# EAGLE board Resistor_Resistor (EAGLE 8.3.0), part 22 of 32
## Placement (x,y rotation side) (continued)
R26721  10K  [0201]  187.5,74.42 0 top
R26722  10K  [0201]  187.5,75.03 0 top
R26723  10K  [0201]  187.5,75.64 0 top
R26724  10K  [0201]  187.5,76.25 0 top
R26725  10K  [0201]  187.5,76.86 0 top
R26726  10K  [0201]  187.5,77.47 0 top
R26727  10K  [0201]  187.5,78.08 0 top
R26728  10K  [0201]  187.5,78.69 0 top
R26729  10K  [0201]  187.5,79.3 0 top
R26730  10K  [0201]  187.5,79.91 0 top
R26731  10K  [0201]  187.5,80.52 0 top
R26732  10K  [0201]  187.5,81.13 0 top
R26733  10K  [0201]  187.5,81.74 0 top
R26734  10K  [0201]  187.5,82.35 0 top
R26735  10K  [0201]  187.5,82.96 0 top
R26736  10K  [0201]  187.5,83.57 0 top
R26737  10K  [0201]  187.5,84.18 0 top
R26738  10K  [0201]  187.5,84.79 0 top
R26739  10K  [0201]  187.5,85.39 0 top
R26740  10K  [0201]  187.5,86 0 top
R26741  10K  [0201]  187.5,86.61 0 top
R26742  10K  [0201]  187.5,87.22 0 top
R26743  10K  [0201]  187.5,87.83 0 top
R26744  10K  [0201]  187.5,88.44 0 top
R26745  10K  [0201]  187.5,89.05 0 top
R26746  10K  [0201]  187.5,89.66 0 top
R26747  10K  [0201]  187.5,90.27 0 top
R26748  10K  [0201]  187.5,90.88 0 top
R26749  10K  [0201]  187.5,91.49 0 top
R26750  10K  [0201]  187.5,92.1 0 top
R26751  10K  [0201]  187.5,92.71 0 top
R26752  10K  [0201]  187.5,93.32 0 top
R26753  10K  [0201]  187.5,93.93 0 top
R26754  10K  [0201]  187.5,94.54 0 top
R26755  10K  [0201]  187.5,95.15 0 top
R26756  10K  [0201]  187.5,95.76 0 top
R26757  10K  [0201]  187.5,96.37 0 top
R26758  10K  [0201]  187.5,96.98 0 top
R26759  10K  [0201]  187.5,97.59 0 top
R26760  10K  [0201]  187.5,98.2 0 top
R26761  10K  [0201]  187.5,98.81 0 top
R26762  10K  [0201]  187.5,99.42 0 top
R26763  10K  [0201]  187.5,100.03 0 top
R26764  10K  [0201]  187.5,100.63 0 top
R26765  10K  [0201]  187.5,101.24 0 top
R26766  10K  [0201]  187.5,101.85 0 top
R26767  10K  [0201]  187.5,102.46 0 top
R26768  10K  [0201]  187.5,103.07 0 top
R26769  10K  [0201]  187.5,103.68 0 top
R26770  10K  [0201]  187.5,104.29 0 top
R26771  10K  [0201]  187.5,104.9 0 top
R26772  10K  [0201]  187.5,105.51 0 top
R26773  10K  [0201]  187.5,106.12 0 top
R26774  10K  [0201]  187.5,106.73 0 top
R26775  10K  [0201]  187.5,107.34 0 top
R26776  10K  [0201]  187.5,107.95 0 top
R26777  10K  [0201]  187.5,108.56 0 top
R26778  10K  [0201]  187.5,109.17 0 top
R26779  10K  [0201]  187.5,109.78 0 top
R26780  10K  [0201]  187.5,110.39 0 top
R26781  10K  [0201]  187.5,111 0 top
R26782  10K  [0201]  187.5,111.61 0 top
R26783  10K  [0201]  187.5,112.22 0 top
R26784  10K  [0201]  187.5,112.83 0 top
R26785  10K  [0201]  187.5,113.44 0 top
R26786  10K  [0201]  187.5,114.05 0 top
R26787  10K  [0201]  187.5,114.66 0 top
R26788  10K  [0201]  187.5,115.27 0 top
R26789  10K  [0201]  187.5,115.87 0 top
R26790  10K  [0201]  187.5,116.48 0 top
R26791  10K  [0201]  187.5,117.09 0 top
R26792  10K  [0201]  187.5,117.7 0 top
R26793  10K  [0201]  187.5,118.31 0 top
R26794  10K  [0201]  187.5,118.92 0 top
R26795  10K  [0201]  187.5,119.53 0 top
R26796  10K  [0201]  187.5,120.14 0 top
R26797  10K  [0201]  187.5,120.75 0 top
R26798  10K  [0201]  187.5,121.36 0 top
R26799  10K  [0201]  187.5,121.97 0 top
R26800  10K  [0201]  187.5,122.58 0 top
R26801  10K  [0201]  188.72,1.27 0 top
R26802  10K  [0201]  188.72,1.88 0 top
R26803  10K  [0201]  188.72,2.49 0 top
R26804  10K  [0201]  188.72,3.1 0 top
R26805  10K  [0201]  188.72,3.71 0 top
R26806  10K  [0201]  188.72,4.32 0 top
R26807  10K  [0201]  188.72,4.93 0 top
R26808  10K  [0201]  188.72,5.54 0 top
R26809  10K  [0201]  188.72,6.15 0 top
R26810  10K  [0201]  188.72,6.76 0 top
R26811  10K  [0201]  188.72,7.37 0 top
R26812  10K  [0201]  188.72,7.98 0 top
R26813  10K  [0201]  188.72,8.59 0 top
R26814  10K  [0201]  188.72,9.19 0 top
R26815  10K  [0201]  188.72,9.8 0 top
R26816  10K  [0201]  188.72,10.41 0 top
R26817  10K  [0201]  188.72,11.02 0 top
R26818  10K  [0201]  188.72,11.63 0 top
R26819  10K  [0201]  188.72,12.24 0 top
R26820  10K  [0201]  188.72,12.85 0 top
R26821  10K  [0201]  188.72,13.46 0 top
R26822  10K  [0201]  188.72,14.07 0 top
R26823  10K  [0201]  188.72,14.68 0 top
R26824  10K  [0201]  188.72,15.29 0 top
R26825  10K  [0201]  188.72,15.9 0 top
R26826  10K  [0201]  188.72,16.51 0 top
R26827  10K  [0201]  188.72,17.12 0 top
R26828  10K  [0201]  188.72,17.73 0 top
R26829  10K  [0201]  188.72,18.34 0 top
R26830  10K  [0201]  188.72,18.95 0 top
R26831  10K  [0201]  188.72,19.56 0 top
R26832  10K  [0201]  188.72,20.17 0 top
R26833  10K  [0201]  188.72,20.78 0 top
R26834  10K  [0201]  188.72,21.39 0 top
R26835  10K  [0201]  188.72,22 0 top
R26836  10K  [0201]  188.72,22.61 0 top
R26837  10K  [0201]  188.72,23.22 0 top
R26838  10K  [0201]  188.72,23.83 0 top
R26839  10K  [0201]  188.72,24.43 0 top
R26840  10K  [0201]  188.72,25.04 0 top
R26841  10K  [0201]  188.72,25.65 0 top
R26842  10K  [0201]  188.72,26.26 0 top
R26843  10K  [0201]  188.72,26.87 0 top
R26844  10K  [0201]  188.72,27.48 0 top
R26845  10K  [0201]  188.72,28.09 0 top
R26846  10K  [0201]  188.72,28.7 0 top
R26847  10K  [0201]  188.72,29.31 0 top
R26848  10K  [0201]  188.72,29.92 0 top
R26849  10K  [0201]  188.72,30.53 0 top
R26850  10K  [0201]  188.72,31.14 0 top
R26851  10K  [0201]  188.72,31.75 0 top
R26852  10K  [0201]  188.72,32.36 0 top
R26853  10K  [0201]  188.72,32.97 0 top
R26854  10K  [0201]  188.72,33.58 0 top
R26855  10K  [0201]  188.72,34.19 0 top
R26856  10K  [0201]  188.72,34.8 0 top
R26857  10K  [0201]  188.72,35.41 0 top
R26858  10K  [0201]  188.72,36.02 0 top
R26859  10K  [0201]  188.72,36.63 0 top
R26860  10K  [0201]  188.72,37.24 0 top
R26861  10K  [0201]  188.72,37.85 0 top
R26862  10K  [0201]  188.72,38.46 0 top
R26863  10K  [0201]  188.72,39.07 0 top
R26864  10K  [0201]  188.72,39.67 0 top
R26865  10K  [0201]  188.72,40.28 0 top
R26866  10K  [0201]  188.72,40.89 0 top
R26867  10K  [0201]  188.72,41.5 0 top
R26868  10K  [0201]  188.72,42.11 0 top
R26869  10K  [0201]  188.72,42.72 0 top
R26870  10K  [0201]  188.72,43.33 0 top
R26871  10K  [0201]  188.72,43.94 0 top
R26872  10K  [0201]  188.72,44.55 0 top
R26873  10K  [0201]  188.72,45.16 0 top
R26874  10K  [0201]  188.72,45.77 0 top
R26875  10K  [0201]  188.72,46.38 0 top
R26876  10K  [0201]  188.72,46.99 0 top
R26877  10K  [0201]  188.72,47.6 0 top
R26878  10K  [0201]  188.72,48.21 0 top
R26879  10K  [0201]  188.72,48.82 0 top
R26880  10K  [0201]  188.72,49.43 0 top
R26881  10K  [0201]  188.72,50.04 0 top
R26882  10K  [0201]  188.72,50.65 0 top
R26883  10K  [0201]  188.72,51.26 0 top
R26884  10K  [0201]  188.72,51.87 0 top
R26885  10K  [0201]  188.72,52.48 0 top
R26886  10K  [0201]  188.72,53.09 0 top
R26887  10K  [0201]  188.72,53.7 0 top
R26888  10K  [0201]  188.72,54.31 0 top
R26889  10K  [0201]  188.72,54.91 0 top
R26890  10K  [0201]  188.72,55.52 0 top
R26891  10K  [0201]  188.72,56.13 0 top
R26892  10K  [0201]  188.72,56.74 0 top
R26893  10K  [0201]  188.72,57.35 0 top
R26894  10K  [0201]  188.72,57.96 0 top
R26895  10K  [0201]  188.72,58.57 0 top
R26896  10K  [0201]  188.72,59.18 0 top
R26897  10K  [0201]  188.72,59.79 0 top
R26898  10K  [0201]  188.72,60.4 0 top
R26899  10K  [0201]  188.72,61.01 0 top
R26900  10K  [0201]  188.72,61.62 0 top
R26901  10K  [0201]  188.72,62.23 0 top
R26902  10K  [0201]  188.72,62.84 0 top
R26903  10K  [0201]  188.72,63.45 0 top
R26904  10K  [0201]  188.72,64.06 0 top
R26905  10K  [0201]  188.72,64.67 0 top
R26906  10K  [0201]  188.72,65.28 0 top
R26907  10K  [0201]  188.72,65.89 0 top
R26908  10K  [0201]  188.72,66.5 0 top
R26909  10K  [0201]  188.72,67.11 0 top
R26910  10K  [0201]  188.72,67.72 0 top
R26911  10K  [0201]  188.72,68.33 0 top
R26912  10K  [0201]  188.72,68.94 0 top
R26913  10K  [0201]  188.72,69.55 0 top
R26914  10K  [0201]  188.72,70.15 0 top
R26915  10K  [0201]  188.72,70.76 0 top
R26916  10K  [0201]  188.72,71.37 0 top
R26917  10K  [0201]  188.72,71.98 0 top
R26918  10K  [0201]  188.72,72.59 0 top
R26919  10K  [0201]  188.72,73.2 0 top
R26920  10K  [0201]  188.72,73.81 0 top
R26921  10K  [0201]  188.72,74.42 0 top
R26922  10K  [0201]  188.72,75.03 0 top
R26923  10K  [0201]  188.72,75.64 0 top
R26924  10K  [0201]  188.72,76.25 0 top
R26925  10K  [0201]  188.72,76.86 0 top
R26926  10K  [0201]  188.72,77.47 0 top
R26927  10K  [0201]  188.72,78.08 0 top
R26928  10K  [0201]  188.72,78.69 0 top
R26929  10K  [0201]  188.72,79.3 0 top
R26930  10K  [0201]  188.72,79.91 0 top
R26931  10K  [0201]  188.72,80.52 0 top
R26932  10K  [0201]  188.72,81.13 0 top
R26933  10K  [0201]  188.72,81.74 0 top
R26934  10K  [0201]  188.72,82.35 0 top
R26935  10K  [0201]  188.72,82.96 0 top
R26936  10K  [0201]  188.72,83.57 0 top
R26937  10K  [0201]  188.72,84.18 0 top
R26938  10K  [0201]  188.72,84.79 0 top
R26939  10K  [0201]  188.72,85.39 0 top
R26940  10K  [0201]  188.72,86 0 top
R26941  10K  [0201]  188.72,86.61 0 top
R26942  10K  [0201]  188.72,87.22 0 top
R26943  10K  [0201]  188.72,87.83 0 top
R26944  10K  [0201]  188.72,88.44 0 top
R26945  10K  [0201]  188.72,89.05 0 top
R26946  10K  [0201]  188.72,89.66 0 top
R26947  10K  [0201]  188.72,90.27 0 top
R26948  10K  [0201]  188.72,90.88 0 top
R26949  10K  [0201]  188.72,91.49 0 top
R26950  10K  [0201]  188.72,92.1 0 top
R26951  10K  [0201]  188.72,92.71 0 top
R26952  10K  [0201]  188.72,93.32 0 top
R26953  10K  [0201]  188.72,93.93 0 top
R26954  10K  [0201]  188.72,94.54 0 top
R26955  10K  [0201]  188.72,95.15 0 top
R26956  10K  [0201]  188.72,95.76 0 top
R26957  10K  [0201]  188.72,96.37 0 top
R26958  10K  [0201]  188.72,96.98 0 top
R26959  10K  [0201]  188.72,97.59 0 top
R26960  10K  [0201]  188.72,98.2 0 top
R26961  10K  [0201]  188.72,98.81 0 top
R26962  10K  [0201]  188.72,99.42 0 top
R26963  10K  [0201]  188.72,100.03 0 top
R26964  10K  [0201]  188.72,100.63 0 top
R26965  10K  [0201]  188.72,101.24 0 top
R26966  10K  [0201]  188.72,101.85 0 top
R26967  10K  [0201]  188.72,102.46 0 top
R26968  10K  [0201]  188.72,103.07 0 top
R26969  10K  [0201]  188.72,103.68 0 top
R26970  10K  [0201]  188.72,104.29 0 top
R26971  10K  [0201]  188.72,104.9 0 top
R26972  10K  [0201]  188.72,105.51 0 top
R26973  10K  [0201]  188.72,106.12 0 top
R26974  10K  [0201]  188.72,106.73 0 top
R26975  10K  [0201]  188.72,107.34 0 top
R26976  10K  [0201]  188.72,107.95 0 top
R26977  10K  [0201]  188.72,108.56 0 top
R26978  10K  [0201]  188.72,109.17 0 top
R26979  10K  [0201]  188.72,109.78 0 top
R26980  10K  [0201]  188.72,110.39 0 top
R26981  10K  [0201]  188.72,111 0 top
R26982  10K  [0201]  188.72,111.61 0 top
R26983  10K  [0201]  188.72,112.22 0 top
R26984  10K  [0201]  188.72,112.83 0 top
R26985  10K  [0201]  188.72,113.44 0 top
R26986  10K  [0201]  188.72,114.05 0 top
R26987  10K  [0201]  188.72,114.66 0 top
R26988  10K  [0201]  188.72,115.27 0 top
R26989  10K  [0201]  188.72,115.87 0 top
R26990  10K  [0201]  188.72,116.48 0 top
R26991  10K  [0201]  188.72,117.09 0 top
R26992  10K  [0201]  188.72,117.7 0 top
R26993  10K  [0201]  188.72,118.31 0 top
R26994  10K  [0201]  188.72,118.92 0 top
R26995  10K  [0201]  188.72,119.53 0 top
R26996  10K  [0201]  188.72,120.14 0 top
R26997  10K  [0201]  188.72,120.75 0 top
R26998  10K  [0201]  188.72,121.36 0 top
R26999  10K  [0201]  188.72,121.97 0 top
R27000  10K  [0201]  188.72,122.58 0 top
R27001  10K  [0201]  189.94,1.27 0 top
R27002  10K  [0201]  189.94,1.88 0 top
R27003  10K  [0201]  189.94,2.49 0 top
R27004  10K  [0201]  189.94,3.1 0 top
R27005  10K  [0201]  189.94,3.71 0 top
R27006  10K  [0201]  189.94,4.32 0 top
R27007  10K  [0201]  189.94,4.93 0 top
R27008  10K  [0201]  189.94,5.54 0 top
R27009  10K  [0201]  189.94,6.15 0 top
R27010  10K  [0201]  189.94,6.76 0 top
R27011  10K  [0201]  189.94,7.37 0 top
R27012  10K  [0201]  189.94,7.98 0 top
R27013  10K  [0201]  189.94,8.59 0 top
R27014  10K  [0201]  189.94,9.19 0 top
R27015  10K  [0201]  189.94,9.8 0 top
R27016  10K  [0201]  189.94,10.41 0 top
R27017  10K  [0201]  189.94,11.02 0 top
R27018  10K  [0201]  189.94,11.63 0 top
R27019  10K  [0201]  189.94,12.24 0 top
R27020  10K  [0201]  189.94,12.85 0 top
R27021  10K  [0201]  189.94,13.46 0 top
R27022  10K  [0201]  189.94,14.07 0 top
R27023  10K  [0201]  189.94,14.68 0 top
R27024  10K  [0201]  189.94,15.29 0 top
R27025  10K  [0201]  189.94,15.9 0 top
R27026  10K  [0201]  189.94,16.51 0 top
R27027  10K  [0201]  189.94,17.12 0 top
R27028  10K  [0201]  189.94,17.73 0 top
R27029  10K  [0201]  189.94,18.34 0 top
R27030  10K  [0201]  189.94,18.95 0 top
R27031  10K  [0201]  189.94,19.56 0 top
R27032  10K  [0201]  189.94,20.17 0 top
R27033  10K  [0201]  189.94,20.78 0 top
R27034  10K  [0201]  189.94,21.39 0 top
R27035  10K  [0201]  189.94,22 0 top
R27036  10K  [0201]  189.94,22.61 0 top
R27037  10K  [0201]  189.94,23.22 0 top
R27038  10K  [0201]  189.94,23.83 0 top
R27039  10K  [0201]  189.94,24.43 0 top
R27040  10K  [0201]  189.94,25.04 0 top
R27041  10K  [0201]  189.94,25.65 0 top
R27042  10K  [0201]  189.94,26.26 0 top
R27043  10K  [0201]  189.94,26.87 0 top
R27044  10K  [0201]  189.94,27.48 0 top
R27045  10K  [0201]  189.94,28.09 0 top
R27046  10K  [0201]  189.94,28.7 0 top
R27047  10K  [0201]  189.94,29.31 0 top
R27048  10K  [0201]  189.94,29.92 0 top
R27049  10K  [0201]  189.94,30.53 0 top
R27050  10K  [0201]  189.94,31.14 0 top
R27051  10K  [0201]  189.94,31.75 0 top
R27052  10K  [0201]  189.94,32.36 0 top
R27053  10K  [0201]  189.94,32.97 0 top
R27054  10K  [0201]  189.94,33.58 0 top
R27055  10K  [0201]  189.94,34.19 0 top
R27056  10K  [0201]  189.94,34.8 0 top
R27057  10K  [0201]  189.94,35.41 0 top
R27058  10K  [0201]  189.94,36.02 0 top
R27059  10K  [0201]  189.94,36.63 0 top
R27060  10K  [0201]  189.94,37.24 0 top
R27061  10K  [0201]  189.94,37.85 0 top
R27062  10K  [0201]  189.94,38.46 0 top
R27063  10K  [0201]  189.94,39.07 0 top
R27064  10K  [0201]  189.94,39.67 0 top
R27065  10K  [0201]  189.94,40.28 0 top
R27066  10K  [0201]  189.94,40.89 0 top
R27067  10K  [0201]  189.94,41.5 0 top
R27068  10K  [0201]  189.94,42.11 0 top
R27069  10K  [0201]  189.94,42.72 0 top
R27070  10K  [0201]  189.94,43.33 0 top
R27071  10K  [0201]  189.94,43.94 0 top
R27072  10K  [0201]  189.94,44.55 0 top
R27073  10K  [0201]  189.94,45.16 0 top
R27074  10K  [0201]  189.94,45.77 0 top
R27075  10K  [0201]  189.94,46.38 0 top
R27076  10K  [0201]  189.94,46.99 0 top
R27077  10K  [0201]  189.94,47.6 0 top
R27078  10K  [0201]  189.94,48.21 0 top
R27079  10K  [0201]  189.94,48.82 0 top
R27080  10K  [0201]  189.94,49.43 0 top
R27081  10K  [0201]  189.94,50.04 0 top
R27082  10K  [0201]  189.94,50.65 0 top
R27083  10K  [0201]  189.94,51.26 0 top
R27084  10K  [0201]  189.94,51.87 0 top
R27085  10K  [0201]  189.94,52.48 0 top
R27086  10K  [0201]  189.94,53.09 0 top
R27087  10K  [0201]  189.94,53.7 0 top
R27088  10K  [0201]  189.94,54.31 0 top
R27089  10K  [0201]  189.94,54.91 0 top
R27090  10K  [0201]  189.94,55.52 0 top
R27091  10K  [0201]  189.94,56.13 0 top
R27092  10K  [0201]  189.94,56.74 0 top
R27093  10K  [0201]  189.94,57.35 0 top
R27094  10K  [0201]  189.94,57.96 0 top
R27095  10K  [0201]  189.94,58.57 0 top
R27096  10K  [0201]  189.94,59.18 0 top
R27097  10K  [0201]  189.94,59.79 0 top
R27098  10K  [0201]  189.94,60.4 0 top
R27099  10K  [0201]  189.94,61.01 0 top
R27100  10K  [0201]  189.94,61.62 0 top
R27101  10K  [0201]  189.94,62.23 0 top
R27102  10K  [0201]  189.94,62.84 0 top
R27103  10K  [0201]  189.94,63.45 0 top
R27104  10K  [0201]  189.94,64.06 0 top
R27105  10K  [0201]  189.94,64.67 0 top
R27106  10K  [0201]  189.94,65.28 0 top
R27107  10K  [0201]  189.94,65.89 0 top
R27108  10K  [0201]  189.94,66.5 0 top
R27109  10K  [0201]  189.94,67.11 0 top
R27110  10K  [0201]  189.94,67.72 0 top
R27111  10K  [0201]  189.94,68.33 0 top
R27112  10K  [0201]  189.94,68.94 0 top
R27113  10K  [0201]  189.94,69.55 0 top
R27114  10K  [0201]  189.94,70.15 0 top
R27115  10K  [0201]  189.94,70.76 0 top
R27116  10K  [0201]  189.94,71.37 0 top
R27117  10K  [0201]  189.94,71.98 0 top
R27118  10K  [0201]  189.94,72.59 0 top
R27119  10K  [0201]  189.94,73.2 0 top
R27120  10K  [0201]  189.94,73.81 0 top
R27121  10K  [0201]  189.94,74.42 0 top
R27122  10K  [0201]  189.94,75.03 0 top
R27123  10K  [0201]  189.94,75.64 0 top
R27124  10K  [0201]  189.94,76.25 0 top
R27125  10K  [0201]  189.94,76.86 0 top
R27126  10K  [0201]  189.94,77.47 0 top
R27127  10K  [0201]  189.94,78.08 0 top
R27128  10K  [0201]  189.94,78.69 0 top
R27129  10K  [0201]  189.94,79.3 0 top
R27130  10K  [0201]  189.94,79.91 0 top
R27131  10K  [0201]  189.94,80.52 0 top
R27132  10K  [0201]  189.94,81.13 0 top
R27133  10K  [0201]  189.94,81.74 0 top
R27134  10K  [0201]  189.94,82.35 0 top
R27135  10K  [0201]  189.94,82.96 0 top
R27136  10K  [0201]  189.94,83.57 0 top
R27137  10K  [0201]  189.94,84.18 0 top
R27138  10K  [0201]  189.94,84.79 0 top
R27139  10K  [0201]  189.94,85.39 0 top
R27140  10K  [0201]  189.94,86 0 top
R27141  10K  [0201]  189.94,86.61 0 top
R27142  10K  [0201]  189.94,87.22 0 top
R27143  10K  [0201]  189.94,87.83 0 top
R27144  10K  [0201]  189.94,88.44 0 top
R27145  10K  [0201]  189.94,89.05 0 top
R27146  10K  [0201]  189.94,89.66 0 top
R27147  10K  [0201]  189.94,90.27 0 top
R27148  10K  [0201]  189.94,90.88 0 top
R27149  10K  [0201]  189.94,91.49 0 top
R27150  10K  [0201]  189.94,92.1 0 top
R27151  10K  [0201]  189.94,92.71 0 top
R27152  10K  [0201]  189.94,93.32 0 top
R27153  10K  [0201]  189.94,93.93 0 top
R27154  10K  [0201]  189.94,94.54 0 top
R27155  10K  [0201]  189.94,95.15 0 top
R27156  10K  [0201]  189.94,95.76 0 top
R27157  10K  [0201]  189.94,96.37 0 top
R27158  10K  [0201]  189.94,96.98 0 top
R27159  10K  [0201]  189.94,97.59 0 top
R27160  10K  [0201]  189.94,98.2 0 top
R27161  10K  [0201]  189.94,98.81 0 top
R27162  10K  [0201]  189.94,99.42 0 top
R27163  10K  [0201]  189.94,100.03 0 top
R27164  10K  [0201]  189.94,100.63 0 top
R27165  10K  [0201]  189.94,101.24 0 top
R27166  10K  [0201]  189.94,101.85 0 top
R27167  10K  [0201]  189.94,102.46 0 top
R27168  10K  [0201]  189.94,103.07 0 top
R27169  10K  [0201]  189.94,103.68 0 top
R27170  10K  [0201]  189.94,104.29 0 top
R27171  10K  [0201]  189.94,104.9 0 top
R27172  10K  [0201]  189.94,105.51 0 top
R27173  10K  [0201]  189.94,106.12 0 top
R27174  10K  [0201]  189.94,106.73 0 top
R27175  10K  [0201]  189.94,107.34 0 top
R27176  10K  [0201]  189.94,107.95 0 top
R27177  10K  [0201]  189.94,108.56 0 top
R27178  10K  [0201]  189.94,109.17 0 top
R27179  10K  [0201]  189.94,109.78 0 top
R27180  10K  [0201]  189.94,110.39 0 top
R27181  10K  [0201]  189.94,111 0 top
R27182  10K  [0201]  189.94,111.61 0 top
R27183  10K  [0201]  189.94,112.22 0 top
R27184  10K  [0201]  189.94,112.83 0 top
R27185  10K  [0201]  189.94,113.44 0 top
R27186  10K  [0201]  189.94,114.05 0 top
R27187  10K  [0201]  189.94,114.66 0 top
R27188  10K  [0201]  189.94,115.27 0 top
R27189  10K  [0201]  189.94,115.87 0 top
R27190  10K  [0201]  189.94,116.48 0 top
R27191  10K  [0201]  189.94,117.09 0 top
R27192  10K  [0201]  189.94,117.7 0 top
R27193  10K  [0201]  189.94,118.31 0 top
R27194  10K  [0201]  189.94,118.92 0 top
R27195  10K  [0201]  189.94,119.53 0 top
R27196  10K  [0201]  189.94,120.14 0 top
R27197  10K  [0201]  189.94,120.75 0 top
R27198  10K  [0201]  189.94,121.36 0 top
R27199  10K  [0201]  189.94,121.97 0 top
R27200  10K  [0201]  189.94,122.58 0 top
R27201  10K  [0201]  191.16,1.27 0 top
R27202  10K  [0201]  191.16,1.88 0 top
R27203  10K  [0201]  191.16,2.49 0 top
R27204  10K  [0201]  191.16,3.1 0 top
R27205  10K  [0201]  191.16,3.71 0 top
R27206  10K  [0201]  191.16,4.32 0 top
R27207  10K  [0201]  191.16,4.93 0 top
R27208  10K  [0201]  191.16,5.54 0 top
R27209  10K  [0201]  191.16,6.15 0 top
R27210  10K  [0201]  191.16,6.76 0 top
R27211  10K  [0201]  191.16,7.37 0 top
R27212  10K  [0201]  191.16,7.98 0 top
R27213  10K  [0201]  191.16,8.59 0 top
R27214  10K  [0201]  191.16,9.19 0 top
R27215  10K  [0201]  191.16,9.8 0 top
R27216  10K  [0201]  191.16,10.41 0 top
R27217  10K  [0201]  191.16,11.02 0 top
R27218  10K  [0201]  191.16,11.63 0 top
R27219  10K  [0201]  191.16,12.24 0 top
R27220  10K  [0201]  191.16,12.85 0 top
R27221  10K  [0201]  191.16,13.46 0 top
R27222  10K  [0201]  191.16,14.07 0 top
R27223  10K  [0201]  191.16,14.68 0 top
R27224  10K  [0201]  191.16,15.29 0 top
R27225  10K  [0201]  191.16,15.9 0 top
R27226  10K  [0201]  191.16,16.51 0 top
R27227  10K  [0201]  191.16,17.12 0 top
R27228  10K  [0201]  191.16,17.73 0 top
R27229  10K  [0201]  191.16,18.34 0 top
R27230  10K  [0201]  191.16,18.95 0 top
R27231  10K  [0201]  191.16,19.56 0 top
R27232  10K  [0201]  191.16,20.17 0 top
R27233  10K  [0201]  191.16,20.78 0 top
R27234  10K  [0201]  191.16,21.39 0 top
R27235  10K  [0201]  191.16,22 0 top
R27236  10K  [0201]  191.16,22.61 0 top
R27237  10K  [0201]  191.16,23.22 0 top
R27238  10K  [0201]  191.16,23.83 0 top
R27239  10K  [0201]  191.16,24.43 0 top
R27240  10K  [0201]  191.16,25.04 0 top
R27241  10K  [0201]  191.16,25.65 0 top
R27242  10K  [0201]  191.16,26.26 0 top
R27243  10K  [0201]  191.16,26.87 0 top
R27244  10K  [0201]  191.16,27.48 0 top
R27245  10K  [0201]  191.16,28.09 0 top
R27246  10K  [0201]  191.16,28.7 0 top
R27247  10K  [0201]  191.16,29.31 0 top
R27248  10K  [0201]  191.16,29.92 0 top
R27249  10K  [0201]  191.16,30.53 0 top
R27250  10K  [0201]  191.16,31.14 0 top
R27251  10K  [0201]  191.16,31.75 0 top
R27252  10K  [0201]  191.16,32.36 0 top
R27253  10K  [0201]  191.16,32.97 0 top
R27254  10K  [0201]  191.16,33.58 0 top
R27255  10K  [0201]  191.16,34.19 0 top
R27256  10K  [0201]  191.16,34.8 0 top
R27257  10K  [0201]  191.16,35.41 0 top
R27258  10K  [0201]  191.16,36.02 0 top
R27259  10K  [0201]  191.16,36.63 0 top
R27260  10K  [0201]  191.16,37.24 0 top
R27261  10K  [0201]  191.16,37.85 0 top
R27262  10K  [0201]  191.16,38.46 0 top
R27263  10K  [0201]  191.16,39.07 0 top
R27264  10K  [0201]  191.16,39.67 0 top
R27265  10K  [0201]  191.16,40.28 0 top
R27266  10K  [0201]  191.16,40.89 0 top
R27267  10K  [0201]  191.16,41.5 0 top
R27268  10K  [0201]  191.16,42.11 0 top
R27269  10K  [0201]  191.16,42.72 0 top
R27270  10K  [0201]  191.16,43.33 0 top
R27271  10K  [0201]  191.16,43.94 0 top
R27272  10K  [0201]  191.16,44.55 0 top
R27273  10K  [0201]  191.16,45.16 0 top
R27274  10K  [0201]  191.16,45.77 0 top
R27275  10K  [0201]  191.16,46.38 0 top
R27276  10K  [0201]  191.16,46.99 0 top
R27277  10K  [0201]  191.16,47.6 0 top
R27278  10K  [0201]  191.16,48.21 0 top
R27279  10K  [0201]  191.16,48.82 0 top
R27280  10K  [0201]  191.16,49.43 0 top
R27281  10K  [0201]  191.16,50.04 0 top
R27282  10K  [0201]  191.16,50.65 0 top
R27283  10K  [0201]  191.16,51.26 0 top
R27284  10K  [0201]  191.16,51.87 0 top
R27285  10K  [0201]  191.16,52.48 0 top
R27286  10K  [0201]  191.16,53.09 0 top
R27287  10K  [0201]  191.16,53.7 0 top
R27288  10K  [0201]  191.16,54.31 0 top
R27289  10K  [0201]  191.16,54.91 0 top
R27290  10K  [0201]  191.16,55.52 0 top
R27291  10K  [0201]  191.16,56.13 0 top
R27292  10K  [0201]  191.16,56.74 0 top
R27293  10K  [0201]  191.16,57.35 0 top
R27294  10K  [0201]  191.16,57.96 0 top
R27295  10K  [0201]  191.16,58.57 0 top
R27296  10K  [0201]  191.16,59.18 0 top
R27297  10K  [0201]  191.16,59.79 0 top
R27298  10K  [0201]  191.16,60.4 0 top
R27299  10K  [0201]  191.16,61.01 0 top
R27300  10K  [0201]  191.16,61.62 0 top
R27301  10K  [0201]  191.16,62.23 0 top
R27302  10K  [0201]  191.16,62.84 0 top
R27303  10K  [0201]  191.16,63.45 0 top
R27304  10K  [0201]  191.16,64.06 0 top
R27305  10K  [0201]  191.16,64.67 0 top
R27306  10K  [0201]  191.16,65.28 0 top
R27307  10K  [0201]  191.16,65.89 0 top
R27308  10K  [0201]  191.16,66.5 0 top
R27309  10K  [0201]  191.16,67.11 0 top
R27310  10K  [0201]  191.16,67.72 0 top
R27311  10K  [0201]  191.16,68.33 0 top
R27312  10K  [0201]  191.16,68.94 0 top
R27313  10K  [0201]  191.16,69.55 0 top
R27314  10K  [0201]  191.16,70.15 0 top
R27315  10K  [0201]  191.16,70.76 0 top
R27316  10K  [0201]  191.16,71.37 0 top
R27317  10K  [0201]  191.16,71.98 0 top
R27318  10K  [0201]  191.16,72.59 0 top
R27319  10K  [0201]  191.16,73.2 0 top
R27320  10K  [0201]  191.16,73.81 0 top
R27321  10K  [0201]  191.16,74.42 0 top
R27322  10K  [0201]  191.16,75.03 0 top
R27323  10K  [0201]  191.16,75.64 0 top
R27324  10K  [0201]  191.16,76.25 0 top
R27325  10K  [0201]  191.16,76.86 0 top
R27326  10K  [0201]  191.16,77.47 0 top
R27327  10K  [0201]  191.16,78.08 0 top
R27328  10K  [0201]  191.16,78.69 0 top
R27329  10K  [0201]  191.16,79.3 0 top
R27330  10K  [0201]  191.16,79.91 0 top
R27331  10K  [0201]  191.16,80.52 0 top
R27332  10K  [0201]  191.16,81.13 0 top
R27333  10K  [0201]  191.16,81.74 0 top
R27334  10K  [0201]  191.16,82.35 0 top
R27335  10K  [0201]  191.16,82.96 0 top
R27336  10K  [0201]  191.16,83.57 0 top
R27337  10K  [0201]  191.16,84.18 0 top
R27338  10K  [0201]  191.16,84.79 0 top
R27339  10K  [0201]  191.16,85.39 0 top
R27340  10K  [0201]  191.16,86 0 top
R27341  10K  [0201]  191.16,86.61 0 top
R27342  10K  [0201]  191.16,87.22 0 top
R27343  10K  [0201]  191.16,87.83 0 top
R27344  10K  [0201]  191.16,88.44 0 top
R27345  10K  [0201]  191.16,89.05 0 top
R27346  10K  [0201]  191.16,89.66 0 top
R27347  10K  [0201]  191.16,90.27 0 top
R27348  10K  [0201]  191.16,90.88 0 top
R27349  10K  [0201]  191.16,91.49 0 top
R27350  10K  [0201]  191.16,92.1 0 top
R27351  10K  [0201]  191.16,92.71 0 top
R27352  10K  [0201]  191.16,93.32 0 top
R27353  10K  [0201]  191.16,93.93 0 top
R27354  10K  [0201]  191.16,94.54 0 top
R27355  10K  [0201]  191.16,95.15 0 top
R27356  10K  [0201]  191.16,95.76 0 top
R27357  10K  [0201]  191.16,96.37 0 top
R27358  10K  [0201]  191.16,96.98 0 top
R27359  10K  [0201]  191.16,97.59 0 top
R27360  10K  [0201]  191.16,98.2 0 top
R27361  10K  [0201]  191.16,98.81 0 top
R27362  10K  [0201]  191.16,99.42 0 top
R27363  10K  [0201]  191.16,100.03 0 top
R27364  10K  [0201]  191.16,100.63 0 top
R27365  10K  [0201]  191.16,101.24 0 top
R27366  10K  [0201]  191.16,101.85 0 top
R27367  10K  [0201]  191.16,102.46 0 top
R27368  10K  [0201]  191.16,103.07 0 top
R27369  10K  [0201]  191.16,103.68 0 top
R27370  10K  [0201]  191.16,104.29 0 top
R27371  10K  [0201]  191.16,104.9 0 top
R27372  10K  [0201]  191.16,105.51 0 top
R27373  10K  [0201]  191.16,106.12 0 top
R27374  10K  [0201]  191.16,106.73 0 top
R27375  10K  [0201]  191.16,107.34 0 top
R27376  10K  [0201]  191.16,107.95 0 top
R27377  10K  [0201]  191.16,108.56 0 top
R27378  10K  [0201]  191.16,109.17 0 top
R27379  10K  [0201]  191.16,109.78 0 top
R27380  10K  [0201]  191.16,110.39 0 top
R27381  10K  [0201]  191.16,111 0 top
R27382  10K  [0201]  191.16,111.61 0 top
R27383  10K  [0201]  191.16,112.22 0 top
R27384  10K  [0201]  191.16,112.83 0 top
R27385  10K  [0201]  191.16,113.44 0 top
R27386  10K  [0201]  191.16,114.05 0 top
R27387  10K  [0201]  191.16,114.66 0 top
R27388  10K  [0201]  191.16,115.27 0 top
R27389  10K  [0201]  191.16,115.87 0 top
R27390  10K  [0201]  191.16,116.48 0 top
R27391  10K  [0201]  191.16,117.09 0 top
R27392  10K  [0201]  191.16,117.7 0 top
R27393  10K  [0201]  191.16,118.31 0 top
R27394  10K  [0201]  191.16,118.92 0 top
R27395  10K  [0201]  191.16,119.53 0 top
R27396  10K  [0201]  191.16,120.14 0 top
R27397  10K  [0201]  191.16,120.75 0 top
R27398  10K  [0201]  191.16,121.36 0 top
R27399  10K  [0201]  191.16,121.97 0 top
R27400  10K  [0201]  191.16,122.58 0 top
R27401  10K  [0201]  192.38,1.27 0 top
R27402  10K  [0201]  192.38,1.88 0 top
R27403  10K  [0201]  192.38,2.49 0 top
R27404  10K  [0201]  192.38,3.1 0 top
R27405  10K  [0201]  192.38,3.71 0 top
R27406  10K  [0201]  192.38,4.32 0 top
R27407  10K  [0201]  192.38,4.93 0 top
R27408  10K  [0201]  192.38,5.54 0 top
R27409  10K  [0201]  192.38,6.15 0 top
R27410  10K  [0201]  192.38,6.76 0 top
R27411  10K  [0201]  192.38,7.37 0 top
R27412  10K  [0201]  192.38,7.98 0 top
R27413  10K  [0201]  192.38,8.59 0 top
R27414  10K  [0201]  192.38,9.19 0 top
R27415  10K  [0201]  192.38,9.8 0 top
R27416  10K  [0201]  192.38,10.41 0 top
R27417  10K  [0201]  192.38,11.02 0 top
R27418  10K  [0201]  192.38,11.63 0 top
R27419  10K  [0201]  192.38,12.24 0 top
R27420  10K  [0201]  192.38,12.85 0 top
R27421  10K  [0201]  192.38,13.46 0 top
R27422  10K  [0201]  192.38,14.07 0 top
R27423  10K  [0201]  192.38,14.68 0 top
R27424  10K  [0201]  192.38,15.29 0 top
R27425  10K  [0201]  192.38,15.9 0 top
R27426  10K  [0201]  192.38,16.51 0 top
R27427  10K  [0201]  192.38,17.12 0 top
R27428  10K  [0201]  192.38,17.73 0 top
R27429  10K  [0201]  192.38,18.34 0 top
R27430  10K  [0201]  192.38,18.95 0 top
R27431  10K  [0201]  192.38,19.56 0 top
R27432  10K  [0201]  192.38,20.17 0 top
R27433  10K  [0201]  192.38,20.78 0 top
R27434  10K  [0201]  192.38,21.39 0 top
R27435  10K  [0201]  192.38,22 0 top
R27436  10K  [0201]  192.38,22.61 0 top
R27437  10K  [0201]  192.38,23.22 0 top
R27438  10K  [0201]  192.38,23.83 0 top
R27439  10K  [0201]  192.38,24.43 0 top
R27440  10K  [0201]  192.38,25.04 0 top
R27441  10K  [0201]  192.38,25.65 0 top
R27442  10K  [0201]  192.38,26.26 0 top
R27443  10K  [0201]  192.38,26.87 0 top
R27444  10K  [0201]  192.38,27.48 0 top
R27445  10K  [0201]  192.38,28.09 0 top
R27446  10K  [0201]  192.38,28.7 0 top
R27447  10K  [0201]  192.38,29.31 0 top
R27448  10K  [0201]  192.38,29.92 0 top
R27449  10K  [0201]  192.38,30.53 0 top
R27450  10K  [0201]  192.38,31.14 0 top
R27451  10K  [0201]  192.38,31.75 0 top
R27452  10K  [0201]  192.38,32.36 0 top
R27453  10K  [0201]  192.38,32.97 0 top
R27454  10K  [0201]  192.38,33.58 0 top
R27455  10K  [0201]  192.38,34.19 0 top
R27456  10K  [0201]  192.38,34.8 0 top
R27457  10K  [0201]  192.38,35.41 0 top
R27458  10K  [0201]  192.38,36.02 0 top
R27459  10K  [0201]  192.38,36.63 0 top
R27460  10K  [0201]  192.38,37.24 0 top
R27461  10K  [0201]  192.38,37.85 0 top
R27462  10K  [0201]  192.38,38.46 0 top
R27463  10K  [0201]  192.38,39.07 0 top
R27464  10K  [0201]  192.38,39.67 0 top
R27465  10K  [0201]  192.38,40.28 0 top
R27466  10K  [0201]  192.38,40.89 0 top
R27467  10K  [0201]  192.38,41.5 0 top
R27468  10K  [0201]  192.38,42.11 0 top
R27469  10K  [0201]  192.38,42.72 0 top
R27470  10K  [0201]  192.38,43.33 0 top
R27471  10K  [0201]  192.38,43.94 0 top
R27472  10K  [0201]  192.38,44.55 0 top
R27473  10K  [0201]  192.38,45.16 0 top
R27474  10K  [0201]  192.38,45.77 0 top
R27475  10K  [0201]  192.38,46.38 0 top
R27476  10K  [0201]  192.38,46.99 0 top
R27477  10K  [0201]  192.38,47.6 0 top
R27478  10K  [0201]  192.38,48.21 0 top
R27479  10K  [0201]  192.38,48.82 0 top
R27480  10K  [0201]  192.38,49.43 0 top
R27481  10K  [0201]  192.38,50.04 0 top
R27482  10K  [0201]  192.38,50.65 0 top
R27483  10K  [0201]  192.38,51.26 0 top
R27484  10K  [0201]  192.38,51.87 0 top
R27485  10K  [0201]  192.38,52.48 0 top
R27486  10K  [0201]  192.38,53.09 0 top
R27487  10K  [0201]  192.38,53.7 0 top
R27488  10K  [0201]  192.38,54.31 0 top
R27489  10K  [0201]  192.38,54.91 0 top
R27490  10K  [0201]  192.38,55.52 0 top
R27491  10K  [0201]  192.38,56.13 0 top
R27492  10K  [0201]  192.38,56.74 0 top
R27493  10K  [0201]  192.38,57.35 0 top
R27494  10K  [0201]  192.38,57.96 0 top
R27495  10K  [0201]  192.38,58.57 0 top
R27496  10K  [0201]  192.38,59.18 0 top
R27497  10K  [0201]  192.38,59.79 0 top
R27498  10K  [0201]  192.38,60.4 0 top
R27499  10K  [0201]  192.38,61.01 0 top
R27500  10K  [0201]  192.38,61.62 0 top
R27501  10K  [0201]  192.38,62.23 0 top
R27502  10K  [0201]  192.38,62.84 0 top
R27503  10K  [0201]  192.38,63.45 0 top
R27504  10K  [0201]  192.38,64.06 0 top
R27505  10K  [0201]  192.38,64.67 0 top
R27506  10K  [0201]  192.38,65.28 0 top
R27507  10K  [0201]  192.38,65.89 0 top
R27508  10K  [0201]  192.38,66.5 0 top
R27509  10K  [0201]  192.38,67.11 0 top
R27510  10K  [0201]  192.38,67.72 0 top
R27511  10K  [0201]  192.38,68.33 0 top
R27512  10K  [0201]  192.38,68.94 0 top
R27513  10K  [0201]  192.38,69.55 0 top
R27514  10K  [0201]  192.38,70.15 0 top
R27515  10K  [0201]  192.38,70.76 0 top
R27516  10K  [0201]  192.38,71.37 0 top
R27517  10K  [0201]  192.38,71.98 0 top
R27518  10K  [0201]  192.38,72.59 0 top
R27519  10K  [0201]  192.38,73.2 0 top
R27520  10K  [0201]  192.38,73.81 0 top
R27521  10K  [0201]  192.38,74.42 0 top
R27522  10K  [0201]  192.38,75.03 0 top
R27523  10K  [0201]  192.38,75.64 0 top
R27524  10K  [0201]  192.38,76.25 0 top
R27525  10K  [0201]  192.38,76.86 0 top
R27526  10K  [0201]  192.38,77.47 0 top
R27527  10K  [0201]  192.38,78.08 0 top
R27528  10K  [0201]  192.38,78.69 0 top
R27529  10K  [0201]  192.38,79.3 0 top
R27530  10K  [0201]  192.38,79.91 0 top
R27531  10K  [0201]  192.38,80.52 0 top
R27532  10K  [0201]  192.38,81.13 0 top
R27533  10K  [0201]  192.38,81.74 0 top
R27534  10K  [0201]  192.38,82.35 0 top
R27535  10K  [0201]  192.38,82.96 0 top
R27536  10K  [0201]  192.38,83.57 0 top
R27537  10K  [0201]  192.38,84.18 0 top
R27538  10K  [0201]  192.38,84.79 0 top
R27539  10K  [0201]  192.38,85.39 0 top
R27540  10K  [0201]  192.38,86 0 top
R27541  10K  [0201]  192.38,86.61 0 top
R27542  10K  [0201]  192.38,87.22 0 top
R27543  10K  [0201]  192.38,87.83 0 top
R27544  10K  [0201]  192.38,88.44 0 top
R27545  10K  [0201]  192.38,89.05 0 top
R27546  10K  [0201]  192.38,89.66 0 top
R27547  10K  [0201]  192.38,90.27 0 top
R27548  10K  [0201]  192.38,90.88 0 top
R27549  10K  [0201]  192.38,91.49 0 top
R27550  10K  [0201]  192.38,92.1 0 top
R27551  10K  [0201]  192.38,92.71 0 top
R27552  10K  [0201]  192.38,93.32 0 top
R27553  10K  [0201]  192.38,93.93 0 top
R27554  10K  [0201]  192.38,94.54 0 top
R27555  10K  [0201]  192.38,95.15 0 top
R27556  10K  [0201]  192.38,95.76 0 top
R27557  10K  [0201]  192.38,96.37 0 top
R27558  10K  [0201]  192.38,96.98 0 top
R27559  10K  [0201]  192.38,97.59 0 top
R27560  10K  [0201]  192.38,98.2 0 top
R27561  10K  [0201]  192.38,98.81 0 top
R27562  10K  [0201]  192.38,99.42 0 top
R27563  10K  [0201]  192.38,100.03 0 top
R27564  10K  [0201]  192.38,100.63 0 top
R27565  10K  [0201]  192.38,101.24 0 top
R27566  10K  [0201]  192.38,101.85 0 top
R27567  10K  [0201]  192.38,102.46 0 top
R27568  10K  [0201]  192.38,103.07 0 top
R27569  10K  [0201]  192.38,103.68 0 top
R27570  10K  [0201]  192.38,104.29 0 top
R27571  10K  [0201]  192.38,104.9 0 top
R27572  10K  [0201]  192.38,105.51 0 top
R27573  10K  [0201]  192.38,106.12 0 top
R27574  10K  [0201]  192.38,106.73 0 top
R27575  10K  [0201]  192.38,107.34 0 top
R27576  10K  [0201]  192.38,107.95 0 top
R27577  10K  [0201]  192.38,108.56 0 top
R27578  10K  [0201]  192.38,109.17 0 top
R27579  10K  [0201]  192.38,109.78 0 top
R27580  10K  [0201]  192.38,110.39 0 top
R27581  10K  [0201]  192.38,111 0 top
R27582  10K  [0201]  192.38,111.61 0 top
R27583  10K  [0201]  192.38,112.22 0 top
R27584  10K  [0201]  192.38,112.83 0 top
R27585  10K  [0201]  192.38,113.44 0 top
R27586  10K  [0201]  192.38,114.05 0 top
R27587  10K  [0201]  192.38,114.66 0 top
R27588  10K  [0201]  192.38,115.27 0 top
R27589  10K  [0201]  192.38,115.87 0 top
R27590  10K  [0201]  192.38,116.48 0 top
R27591  10K  [0201]  192.38,117.09 0 top
R27592  10K  [0201]  192.38,117.7 0 top
R27593  10K  [0201]  192.38,118.31 0 top
R27594  10K  [0201]  192.38,118.92 0 top
R27595  10K  [0201]  192.38,119.53 0 top
R27596  10K  [0201]  192.38,120.14 0 top
R27597  10K  [0201]  192.38,120.75 0 top
R27598  10K  [0201]  192.38,121.36 0 top
R27599  10K  [0201]  192.38,121.97 0 top
R27600  10K  [0201]  192.38,122.58 0 top
R27601  10K  [0201]  193.6,1.27 0 top
R27602  10K  [0201]  193.6,1.88 0 top
R27603  10K  [0201]  193.6,2.49 0 top
R27604  10K  [0201]  193.6,3.1 0 top
R27605  10K  [0201]  193.6,3.71 0 top
R27606  10K  [0201]  193.6,4.32 0 top
R27607  10K  [0201]  193.6,4.93 0 top
R27608  10K  [0201]  193.6,5.54 0 top
R27609  10K  [0201]  193.6,6.15 0 top
R27610  10K  [0201]  193.6,6.76 0 top
R27611  10K  [0201]  193.6,7.37 0 top
R27612  10K  [0201]  193.6,7.98 0 top
R27613  10K  [0201]  193.6,8.59 0 top
R27614  10K  [0201]  193.6,9.19 0 top
R27615  10K  [0201]  193.6,9.8 0 top
R27616  10K  [0201]  193.6,10.41 0 top
R27617  10K  [0201]  193.6,11.02 0 top
R27618  10K  [0201]  193.6,11.63 0 top
R27619  10K  [0201]  193.6,12.24 0 top
R27620  10K  [0201]  193.6,12.85 0 top
R27621  10K  [0201]  193.6,13.46 0 top
R27622  10K  [0201]  193.6,14.07 0 top
R27623  10K  [0201]  193.6,14.68 0 top
R27624  10K  [0201]  193.6,15.29 0 top
R27625  10K  [0201]  193.6,15.9 0 top
R27626  10K  [0201]  193.6,16.51 0 top
R27627  10K  [0201]  193.6,17.12 0 top
R27628  10K  [0201]  193.6,17.73 0 top
R27629  10K  [0201]  193.6,18.34 0 top
R27630  10K  [0201]  193.6,18.95 0 top
R27631  10K  [0201]  193.6,19.56 0 top
R27632  10K  [0201]  193.6,20.17 0 top
R27633  10K  [0201]  193.6,20.78 0 top
R27634  10K  [0201]  193.6,21.39 0 top
R27635  10K  [0201]  193.6,22 0 top
R27636  10K  [0201]  193.6,22.61 0 top
R27637  10K  [0201]  193.6,23.22 0 top
R27638  10K  [0201]  193.6,23.83 0 top
R27639  10K  [0201]  193.6,24.43 0 top
R27640  10K  [0201]  193.6,25.04 0 top
R27641  10K  [0201]  193.6,25.65 0 top
R27642  10K  [0201]  193.6,26.26 0 top
R27643  10K  [0201]  193.6,26.87 0 top
R27644  10K  [0201]  193.6,27.48 0 top
R27645  10K  [0201]  193.6,28.09 0 top
R27646  10K  [0201]  193.6,28.7 0 top
R27647  10K  [0201]  193.6,29.31 0 top
R27648  10K  [0201]  193.6,29.92 0 top
R27649  10K  [0201]  193.6,30.53 0 top
R27650  10K  [0201]  193.6,31.14 0 top
R27651  10K  [0201]  193.6,31.75 0 top
R27652  10K  [0201]  193.6,32.36 0 top
R27653  10K  [0201]  193.6,32.97 0 top
R27654  10K  [0201]  193.6,33.58 0 top
R27655  10K  [0201]  193.6,34.19 0 top
R27656  10K  [0201]  193.6,34.8 0 top
R27657  10K  [0201]  193.6,35.41 0 top
R27658  10K  [0201]  193.6,36.02 0 top
R27659  10K  [0201]  193.6,36.63 0 top
R27660  10K  [0201]  193.6,37.24 0 top
R27661  10K  [0201]  193.6,37.85 0 top
R27662  10K  [0201]  193.6,38.46 0 top
R27663  10K  [0201]  193.6,39.07 0 top
R27664  10K  [0201]  193.6,39.67 0 top
R27665  10K  [0201]  193.6,40.28 0 top
R27666  10K  [0201]  193.6,40.89 0 top
R27667  10K  [0201]  193.6,41.5 0 top
R27668  10K  [0201]  193.6,42.11 0 top
R27669  10K  [0201]  193.6,42.72 0 top
R27670  10K  [0201]  193.6,43.33 0 top
R27671  10K  [0201]  193.6,43.94 0 top
R27672  10K  [0201]  193.6,44.55 0 top
R27673  10K  [0201]  193.6,45.16 0 top
R27674  10K  [0201]  193.6,45.77 0 top
R27675  10K  [0201]  193.6,46.38 0 top
R27676  10K  [0201]  193.6,46.99 0 top
R27677  10K  [0201]  193.6,47.6 0 top
R27678  10K  [0201]  193.6,48.21 0 top
R27679  10K  [0201]  193.6,48.82 0 top
R27680  10K  [0201]  193.6,49.43 0 top
R27681  10K  [0201]  193.6,50.04 0 top
R27682  10K  [0201]  193.6,50.65 0 top
R27683  10K  [0201]  193.6,51.26 0 top
R27684  10K  [0201]  193.6,51.87 0 top
R27685  10K  [0201]  193.6,52.48 0 top
R27686  10K  [0201]  193.6,53.09 0 top
R27687  10K  [0201]  193.6,53.7 0 top
R27688  10K  [0201]  193.6,54.31 0 top
R27689  10K  [0201]  193.6,54.91 0 top
R27690  10K  [0201]  193.6,55.52 0 top
R27691  10K  [0201]  193.6,56.13 0 top
R27692  10K  [0201]  193.6,56.74 0 top
R27693  10K  [0201]  193.6,57.35 0 top
R27694  10K  [0201]  193.6,57.96 0 top
R27695  10K  [0201]  193.6,58.57 0 top
R27696  10K  [0201]  193.6,59.18 0 top
R27697  10K  [0201]  193.6,59.79 0 top
R27698  10K  [0201]  193.6,60.4 0 top
R27699  10K  [0201]  193.6,61.01 0 top
R27700  10K  [0201]  193.6,61.62 0 top
R27701  10K  [0201]  193.6,62.23 0 top
R27702  10K  [0201]  193.6,62.84 0 top
R27703  10K  [0201]  193.6,63.45 0 top
R27704  10K  [0201]  193.6,64.06 0 top
R27705  10K  [0201]  193.6,64.67 0 top
R27706  10K  [0201]  193.6,65.28 0 top
R27707  10K  [0201]  193.6,65.89 0 top
R27708  10K  [0201]  193.6,66.5 0 top
R27709  10K  [0201]  193.6,67.11 0 top
R27710  10K  [0201]  193.6,67.72 0 top
R27711  10K  [0201]  193.6,68.33 0 top
R27712  10K  [0201]  193.6,68.94 0 top
R27713  10K  [0201]  193.6,69.55 0 top
R27714  10K  [0201]  193.6,70.15 0 top
R27715  10K  [0201]  193.6,70.76 0 top
R27716  10K  [0201]  193.6,71.37 0 top
R27717  10K  [0201]  193.6,71.98 0 top
R27718  10K  [0201]  193.6,72.59 0 top
R27719  10K  [0201]  193.6,73.2 0 top
R27720  10K  [0201]  193.6,73.81 0 top
R27721  10K  [0201]  193.6,74.42 0 top
R27722  10K  [0201]  193.6,75.03 0 top
R27723  10K  [0201]  193.6,75.64 0 top
R27724  10K  [0201]  193.6,76.25 0 top
R27725  10K  [0201]  193.6,76.86 0 top
R27726  10K  [0201]  193.6,77.47 0 top
R27727  10K  [0201]  193.6,78.08 0 top
R27728  10K  [0201]  193.6,78.69 0 top
R27729  10K  [0201]  193.6,79.3 0 top
R27730  10K  [0201]  193.6,79.91 0 top
R27731  10K  [0201]  193.6,80.52 0 top
R27732  10K  [0201]  193.6,81.13 0 top
R27733  10K  [0201]  193.6,81.74 0 top
R27734  10K  [0201]  193.6,82.35 0 top
R27735  10K  [0201]  193.6,82.96 0 top
R27736  10K  [0201]  193.6,83.57 0 top
R27737  10K  [0201]  193.6,84.18 0 top
R27738  10K  [0201]  193.6,84.79 0 top
R27739  10K  [0201]  193.6,85.39 0 top
R27740  10K  [0201]  193.6,86 0 top
R27741  10K  [0201]  193.6,86.61 0 top
R27742  10K  [0201]  193.6,87.22 0 top
R27743  10K  [0201]  193.6,87.83 0 top
R27744  10K  [0201]  193.6,88.44 0 top
R27745  10K  [0201]  193.6,89.05 0 top
R27746  10K  [0201]  193.6,89.66 0 top
R27747  10K  [0201]  193.6,90.27 0 top
R27748  10K  [0201]  193.6,90.88 0 top
R27749  10K  [0201]  193.6,91.49 0 top
R27750  10K  [0201]  193.6,92.1 0 top
R27751  10K  [0201]  193.6,92.71 0 top
R27752  10K  [0201]  193.6,93.32 0 top
R27753  10K  [0201]  193.6,93.93 0 top
R27754  10K  [0201]  193.6,94.54 0 top
R27755  10K  [0201]  193.6,95.15 0 top
R27756  10K  [0201]  193.6,95.76 0 top
R27757  10K  [0201]  193.6,96.37 0 top
R27758  10K  [0201]  193.6,96.98 0 top
R27759  10K  [0201]  193.6,97.59 0 top
R27760  10K  [0201]  193.6,98.2 0 top
R27761  10K  [0201]  193.6,98.81 0 top
R27762  10K  [0201]  193.6,99.42 0 top
R27763  10K  [0201]  193.6,100.03 0 top
R27764  10K  [0201]  193.6,100.63 0 top
R27765  10K  [0201]  193.6,101.24 0 top
R27766  10K  [0201]  193.6,101.85 0 top
R27767  10K  [0201]  193.6,102.46 0 top
R27768  10K  [0201]  193.6,103.07 0 top
R27769  10K  [0201]  193.6,103.68 0 top
R27770  10K  [0201]  193.6,104.29 0 top
R27771  10K  [0201]  193.6,104.9 0 top
R27772  10K  [0201]  193.6,105.51 0 top
R27773  10K  [0201]  193.6,106.12 0 top
R27774  10K  [0201]  193.6,106.73 0 top
R27775  10K  [0201]  193.6,107.34 0 top
R27776  10K  [0201]  193.6,107.95 0 top
R27777  10K  [0201]  193.6,108.56 0 top
R27778  10K  [0201]  193.6,109.17 0 top
R27779  10K  [0201]  193.6,109.78 0 top
R27780  10K  [0201]  193.6,110.39 0 top
R27781  10K  [0201]  193.6,111 0 top
R27782  10K  [0201]  193.6,111.61 0 top
R27783  10K  [0201]  193.6,112.22 0 top
R27784  10K  [0201]  193.6,112.83 0 top
R27785  10K  [0201]  193.6,113.44 0 top
R27786  10K  [0201]  193.6,114.05 0 top
R27787  10K  [0201]  193.6,114.66 0 top
R27788  10K  [0201]  193.6,115.27 0 top
R27789  10K  [0201]  193.6,115.87 0 top
R27790  10K  [0201]  193.6,116.48 0 top
R27791  10K  [0201]  193.6,117.09 0 top
R27792  10K  [0201]  193.6,117.7 0 top
R27793  10K  [0201]  193.6,118.31 0 top
R27794  10K  [0201]  193.6,118.92 0 top
R27795  10K  [0201]  193.6,119.53 0 top
R27796  10K  [0201]  193.6,120.14 0 top
R27797  10K  [0201]  193.6,120.75 0 top
R27798  10K  [0201]  193.6,121.36 0 top
R27799  10K  [0201]  193.6,121.97 0 top
R27800  10K  [0201]  193.6,122.58 0 top
R27801  10K  [0201]  194.82,1.27 0 top
R27802  10K  [0201]  194.82,1.88 0 top
R27803  10K  [0201]  194.82,2.49 0 top
R27804  10K  [0201]  194.82,3.1 0 top
R27805  10K  [0201]  194.82,3.71 0 top
R27806  10K  [0201]  194.82,4.32 0 top
R27807  10K  [0201]  194.82,4.93 0 top
R27808  10K  [0201]  194.82,5.54 0 top
R27809  10K  [0201]  194.82,6.15 0 top
R27810  10K  [0201]  194.82,6.76 0 top
R27811  10K  [0201]  194.82,7.37 0 top
R27812  10K  [0201]  194.82,7.98 0 top
R27813  10K  [0201]  194.82,8.59 0 top
R27814  10K  [0201]  194.82,9.19 0 top
R27815  10K  [0201]  194.82,9.8 0 top
R27816  10K  [0201]  194.82,10.41 0 top
R27817  10K  [0201]  194.82,11.02 0 top
R27818  10K  [0201]  194.82,11.63 0 top
R27819  10K  [0201]  194.82,12.24 0 top
R27820  10K  [0201]  194.82,12.85 0 top
R27821  10K  [0201]  194.82,13.46 0 top
R27822  10K  [0201]  194.82,14.07 0 top
R27823  10K  [0201]  194.82,14.68 0 top
R27824  10K  [0201]  194.82,15.29 0 top
R27825  10K  [0201]  194.82,15.9 0 top
R27826  10K  [0201]  194.82,16.51 0 top
R27827  10K  [0201]  194.82,17.12 0 top
R27828  10K  [0201]  194.82,17.73 0 top
R27829  10K  [0201]  194.82,18.34 0 top
R27830  10K  [0201]  194.82,18.95 0 top
R27831  10K  [0201]  194.82,19.56 0 top
R27832  10K  [0201]  194.82,20.17 0 top
R27833  10K  [0201]  194.82,20.78 0 top
R27834  10K  [0201]  194.82,21.39 0 top
R27835  10K  [0201]  194.82,22 0 top
R27836  10K  [0201]  194.82,22.61 0 top
R27837  10K  [0201]  194.82,23.22 0 top
R27838  10K  [0201]  194.82,23.83 0 top
R27839  10K  [0201]  194.82,24.43 0 top
R27840  10K  [0201]  194.82,25.04 0 top
R27841  10K  [0201]  194.82,25.65 0 top
R27842  10K  [0201]  194.82,26.26 0 top
R27843  10K  [0201]  194.82,26.87 0 top
R27844  10K  [0201]  194.82,27.48 0 top
R27845  10K  [0201]  194.82,28.09 0 top
R27846  10K  [0201]  194.82,28.7 0 top
R27847  10K  [0201]  194.82,29.31 0 top
R27848  10K  [0201]  194.82,29.92 0 top
R27849  10K  [0201]  194.82,30.53 0 top
R27850  10K  [0201]  194.82,31.14 0 top
R27851  10K  [0201]  194.82,31.75 0 top
R27852  10K  [0201]  194.82,32.36 0 top
R27853  10K  [0201]  194.82,32.97 0 top
R27854  10K  [0201]  194.82,33.58 0 top
R27855  10K  [0201]  194.82,34.19 0 top
R27856  10K  [0201]  194.82,34.8 0 top
R27857  10K  [0201]  194.82,35.41 0 top
R27858  10K  [0201]  194.82,36.02 0 top
R27859  10K  [0201]  194.82,36.63 0 top
R27860  10K  [0201]  194.82,37.24 0 top
R27861  10K  [0201]  194.82,37.85 0 top
R27862  10K  [0201]  194.82,38.46 0 top
R27863  10K  [0201]  194.82,39.07 0 top
R27864  10K  [0201]  194.82,39.67 0 top
R27865  10K  [0201]  194.82,40.28 0 top
R27866  10K  [0201]  194.82,40.89 0 top
R27867  10K  [0201]  194.82,41.5 0 top
R27868  10K  [0201]  194.82,42.11 0 top
R27869  10K  [0201]  194.82,42.72 0 top
R27870  10K  [0201]  194.82,43.33 0 top
R27871  10K  [0201]  194.82,43.94 0 top
R27872  10K  [0201]  194.82,44.55 0 top
R27873  10K  [0201]  194.82,45.16 0 top
R27874  10K  [0201]  194.82,45.77 0 top
R27875  10K  [0201]  194.82,46.38 0 top
R27876  10K  [0201]  194.82,46.99 0 top
R27877  10K  [0201]  194.82,47.6 0 top
R27878  10K  [0201]  194.82,48.21 0 top
R27879  10K  [0201]  194.82,48.82 0 top
R27880  10K  [0201]  194.82,49.43 0 top
R27881  10K  [0201]  194.82,50.04 0 top
R27882  10K  [0201]  194.82,50.65 0 top
R27883  10K  [0201]  194.82,51.26 0 top
R27884  10K  [0201]  194.82,51.87 0 top
R27885  10K  [0201]  194.82,52.48 0 top
R27886  10K  [0201]  194.82,53.09 0 top
R27887  10K  [0201]  194.82,53.7 0 top
R27888  10K  [0201]  194.82,54.31 0 top
R27889  10K  [0201]  194.82,54.91 0 top
R27890  10K  [0201]  194.82,55.52 0 top
R27891  10K  [0201]  194.82,56.13 0 top
R27892  10K  [0201]  194.82,56.74 0 top
R27893  10K  [0201]  194.82,57.35 0 top
R27894  10K  [0201]  194.82,57.96 0 top
R27895  10K  [0201]  194.82,58.57 0 top
R27896  10K  [0201]  194.82,59.18 0 top
R27897  10K  [0201]  194.82,59.79 0 top
R27898  10K  [0201]  194.82,60.4 0 top
R27899  10K  [0201]  194.82,61.01 0 top
R27900  10K  [0201]  194.82,61.62 0 top
R27901  10K  [0201]  194.82,62.23 0 top
R27902  10K  [0201]  194.82,62.84 0 top
R27903  10K  [0201]  194.82,63.45 0 top
R27904  10K  [0201]  194.82,64.06 0 top
R27905  10K  [0201]  194.82,64.67 0 top
R27906  10K  [0201]  194.82,65.28 0 top
R27907  10K  [0201]  194.82,65.89 0 top
R27908  10K  [0201]  194.82,66.5 0 top
R27909  10K  [0201]  194.82,67.11 0 top
R27910  10K  [0201]  194.82,67.72 0 top
R27911  10K  [0201]  194.82,68.33 0 top
R27912  10K  [0201]  194.82,68.94 0 top
R27913  10K  [0201]  194.82,69.55 0 top
R27914  10K  [0201]  194.82,70.15 0 top
R27915  10K  [0201]  194.82,70.76 0 top
R27916  10K  [0201]  194.82,71.37 0 top
R27917  10K  [0201]  194.82,71.98 0 top
R27918  10K  [0201]  194.82,72.59 0 top
R27919  10K  [0201]  194.82,73.2 0 top
R27920  10K  [0201]  194.82,73.81 0 top
R27921  10K  [0201]  194.82,74.42 0 top
R27922  10K  [0201]  194.82,75.03 0 top
R27923  10K  [0201]  194.82,75.64 0 top
R27924  10K  [0201]  194.82,76.25 0 top
R27925  10K  [0201]  194.82,76.86 0 top
R27926  10K  [0201]  194.82,77.47 0 top
R27927  10K  [0201]  194.82,78.08 0 top
R27928  10K  [0201]  194.82,78.69 0 top
R27929  10K  [0201]  194.82,79.3 0 top
R27930  10K  [0201]  194.82,79.91 0 top
R27931  10K  [0201]  194.82,80.52 0 top
R27932  10K  [0201]  194.82,81.13 0 top
R27933  10K  [0201]  194.82,81.74 0 top
R27934  10K  [0201]  194.82,82.35 0 top
R27935  10K  [0201]  194.82,82.96 0 top
R27936  10K  [0201]  194.82,83.57 0 top
R27937  10K  [0201]  194.82,84.18 0 top
R27938  10K  [0201]  194.82,84.79 0 top
R27939  10K  [0201]  194.82,85.39 0 top
R27940  10K  [0201]  194.82,86 0 top
R27941  10K  [0201]  194.82,86.61 0 top
R27942  10K  [0201]  194.82,87.22 0 top
R27943  10K  [0201]  194.82,87.83 0 top
R27944  10K  [0201]  194.82,88.44 0 top
R27945  10K  [0201]  194.82,89.05 0 top
R27946  10K  [0201]  194.82,89.66 0 top
R27947  10K  [0201]  194.82,90.27 0 top
R27948  10K  [0201]  194.82,90.88 0 top
R27949  10K  [0201]  194.82,91.49 0 top
R27950  10K  [0201]  194.82,92.1 0 top
R27951  10K  [0201]  194.82,92.71 0 top
R27952  10K  [0201]  194.82,93.32 0 top
R27953  10K  [0201]  194.82,93.93 0 top
R27954  10K  [0201]  194.82,94.54 0 top
R27955  10K  [0201]  194.82,95.15 0 top
R27956  10K  [0201]  194.82,95.76 0 top
R27957  10K  [0201]  194.82,96.37 0 top
R27958  10K  [0201]  194.82,96.98 0 top
R27959  10K  [0201]  194.82,97.59 0 top
R27960  10K  [0201]  194.82,98.2 0 top
R27961  10K  [0201]  194.82,98.81 0 top
R27962  10K  [0201]  194.82,99.42 0 top
R27963  10K  [0201]  194.82,100.03 0 top
R27964  10K  [0201]  194.82,100.63 0 top
R27965  10K  [0201]  194.82,101.24 0 top
R27966  10K  [0201]  194.82,101.85 0 top
R27967  10K  [0201]  194.82,102.46 0 top
R27968  10K  [0201]  194.82,103.07 0 top
R27969  10K  [0201]  194.82,103.68 0 top